# Altium schematic sheet Minion.SchDoc (part 4 of 4)
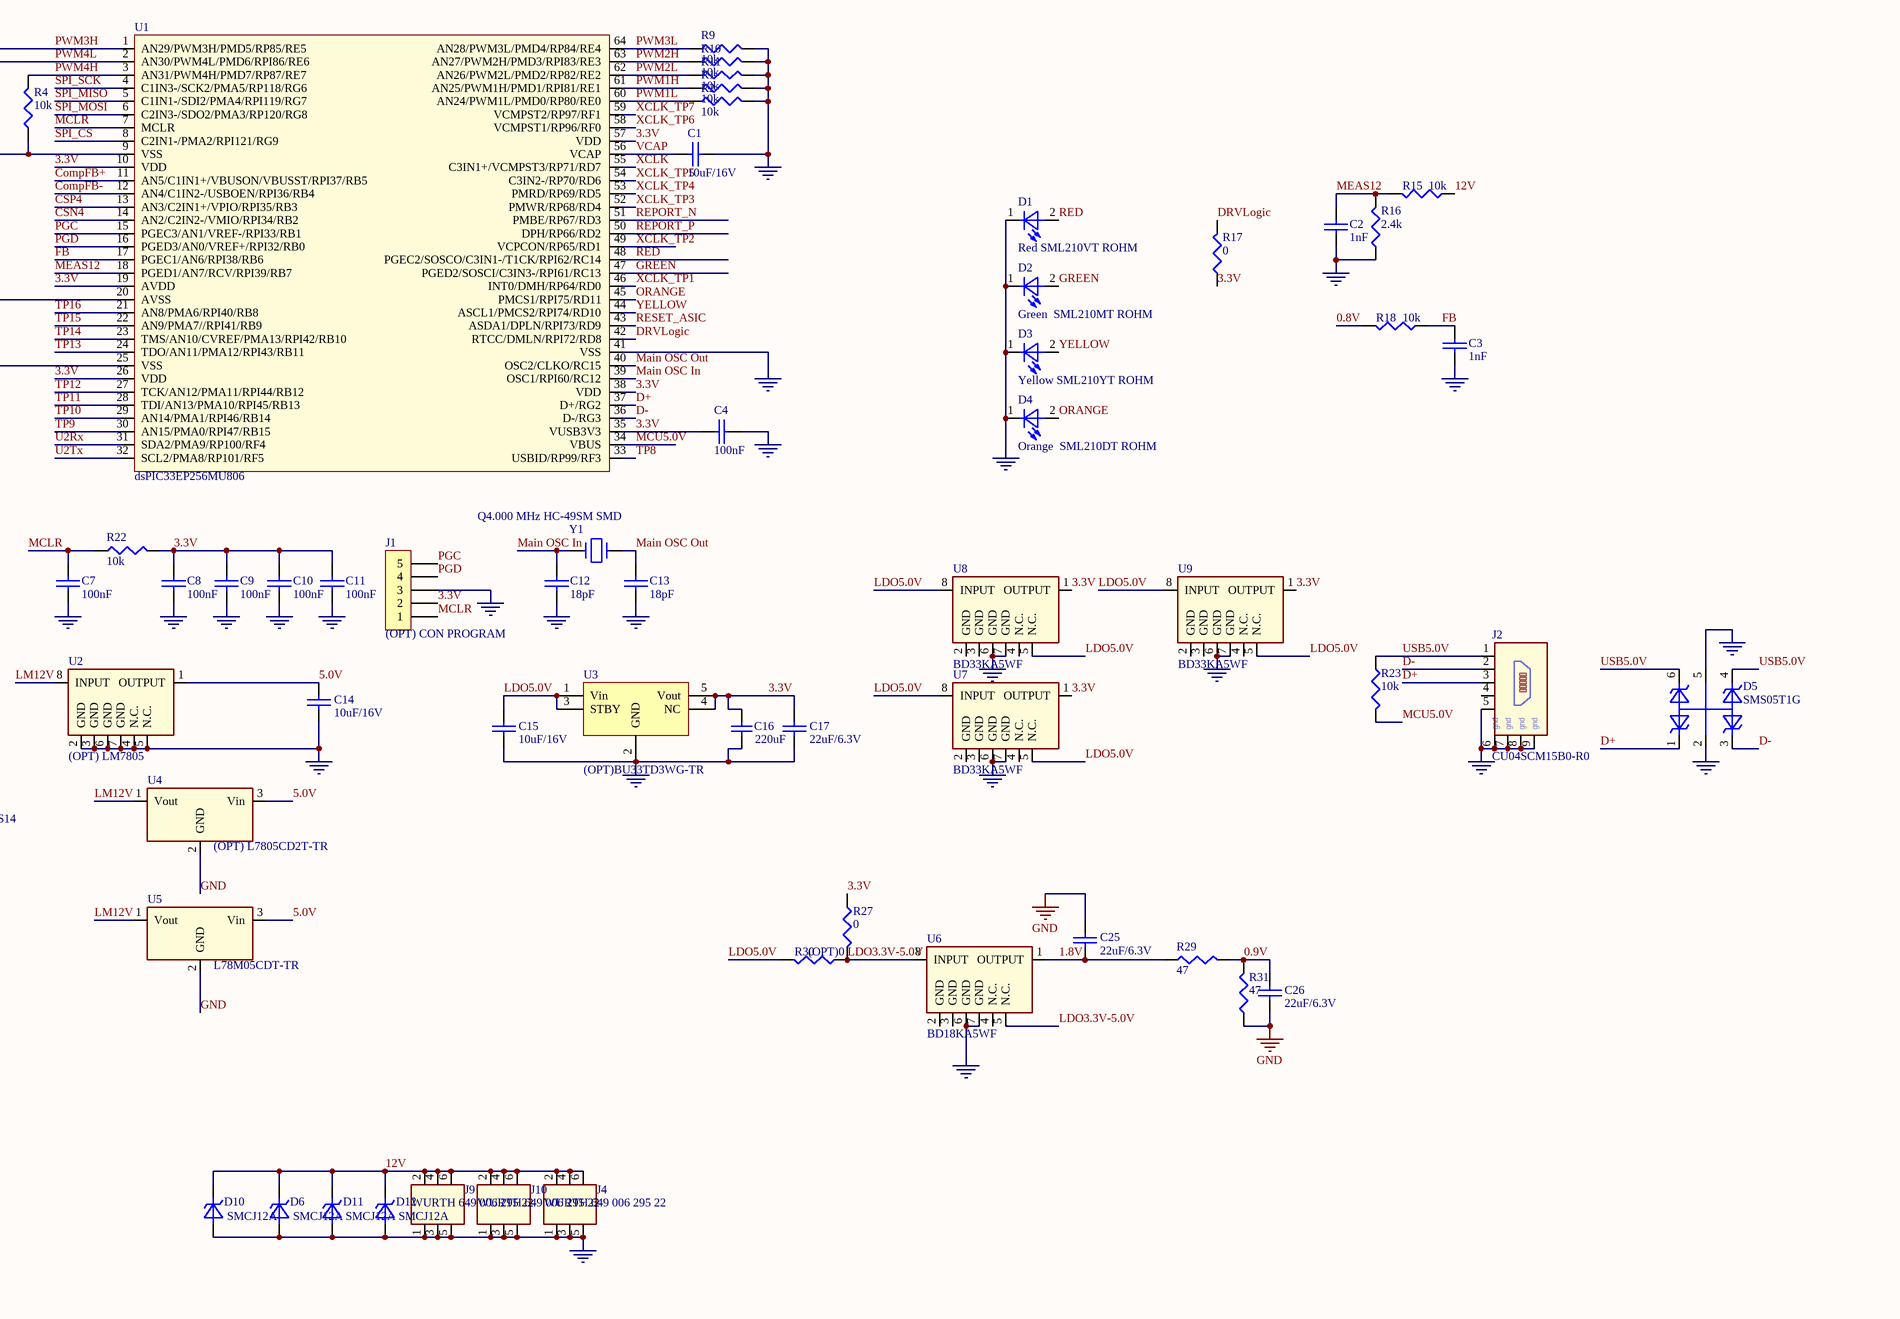
[diagram p8: Minion.SchDoc, bottom right]

## Notes on the sheet
- (in symbol CON_USB_MINI_1) gnd

## Library data of the parts
C1 C1P_1-C1P_8 C2 C2P_1-C2P_8 C3 C3P_1-C3P_8 C4 C7-C15 C17 C25 C26 CO1_1-CO1_4 CO2_1-CO2_4 CO4_1-CO4_4 CO5_1-CO5_4 CO6_1-CO6_4 CO7_1-CO7_4 CO8_1-CO8_4 = CAP: Capacitor
  C3 CO1_1-CO1_4 CO2_1-CO2_4 CO5_1-CO5_4 CO6_1-CO6_4 CO7_1-CO7_4 CO8_1-CO8_4: Manufacturer PN: *
C4P_1-C4P_8 C5P_1-C5P_8 C6P_1-C6P_8 C7P_1-C7P_8 C8P_1-C8P_8 C9P_1-C9P_8 C10P_1-C10P_8 C11P_1-C11P_8 C12P_1-C12P_8 C16 CF_1-CF_112 CM_1-CM_112 CO3_1-CO3_4 = Cap Semi: CL32A227MQVNNNE 220UF 6.3V 20% X5R 1210; Published: 8-Jun-2000; LatestRevisionDate: 29-May-2009; LatestRevisionNote: IPC-7351 Footprint Added.; PackageReference: C1206; Publisher: Altium Limited; PackageDescription: Chip Capacitor
  C4P_1-C4P_8 C5P_1-C5P_8 C9P_1-C9P_8 C10P_1-C10P_8 C11P_1-C11P_8 C12P_1-C12P_8: Value: 100uF
  C6P_1-C6P_8 C7P_1-C7P_8 C8P_1-C8P_8 C16 CO3_1-CO3_4: Value: 220uF
  CF_1-CF_112 CM_1-CM_112: Value: (OPT)220uF
D1-D4 DI1_1-DI1_4 DI2_1-DI2_4 DI3_1-DI3_4 DI4_1-DI4_4 DI5_1-DI5_4 DI6_1-DI6_4 DI7_1-DI7_4 DI8_1-DI8_4 DI9_1-DI9_4 = LED_2: NOTE: <NOTE>
D1P_1-D1P_8 = D_DUAL_A1A2CC3: NOTE: <NOTE>
D5 = D_TVS_QUAD_C1AA2AA5C3C4C6: 4 IO lines TVS; NOTE: <NOTE>
D6 D10-D12 = D_TVS_UNI: Еднопосочен трансил, 600W, UBRmin13.3V@1mA; NOTE: <NOTE>
D7-D9 = D_STKY: NOTE: <NOTE>
J1 = CON5: Connector
J2 = CON_USB_MINI_1: NOTE: <NOTE>
J4 J9 J10 = CON_PCI-E: 4.20mm Male Dual Row Angled Header WR-MPC4
J12-J15 = CON_4PINS
L1P_1-L1P_8 = L
Q1P_1-Q1P_8 Q2P_1-Q2P_8 Q3P_1-Q3P_8 = MOS_N_D1_S1S2S3G4D5D6D7D8: NOTE: <NOTE>
QO1_1-QO1_4 = BJT_NPN_B1E2C3: NOTE: <NOTE>
R1-R4 R9-R12 R15-R18 R22 R23 R25-R31 RI1_1-RI1_4 RI2_1-RI2_4 RO1_1-RO1_4 RO2_1-RO2_4 RO3_1-RO3_4 = Res3: Resistor; Published: 8-Jun-2000; LatestRevisionDate: 29-May-2009; LatestRevisionNote: IPC-7351 Footprint Added.; PackageReference: J1-0603; Publisher: Altium Limited; PackageDescription: Chip Resistor
  R1-R4 R9-R12 R15 R22 R23: Value: 10k
  R16: Value: 2.4k
  R17 R25 R27 RI1_1-RI1_4 RI2_1-RI2_4 RO1_1-RO1_4: Value: 0
  R18 RO3_1-RO3_4: Value: 10k; Manufacturer PN: *
  R26: Value: 2
  R28: Value: 100
  R29 R31: Value: 47
  R30: Value: (OPT)0
  RO2_1-RO2_4: Value: 1k
U1_1-U1_4 = Minion BGA900
U1P_1-U1P_8 = DRVFET_LTC4442: Mosfet 12V Dual Bootstrapped PWM Sync Buck Optimised
U2 U6-U9 = IC_LM2931AD-5.0R2G_SO-8
U3 = VOLTREG LDO
U4 U5 = IC_Vout1GND2Vin3: NOTE: <NOTE>
Y1 YO2_1-YO2_4 = CRYSTAL
YO1_1-YO1_4 YO3_1-YO3_4 YO4_1-YO4_4 YO5_1-YO5_4 = XTAL_OE1GND2OSC3VDD4: NOTE: <NOTE>